# EasyEDA Pro project BlueberryPi.eprj, board PCB1 (continued)
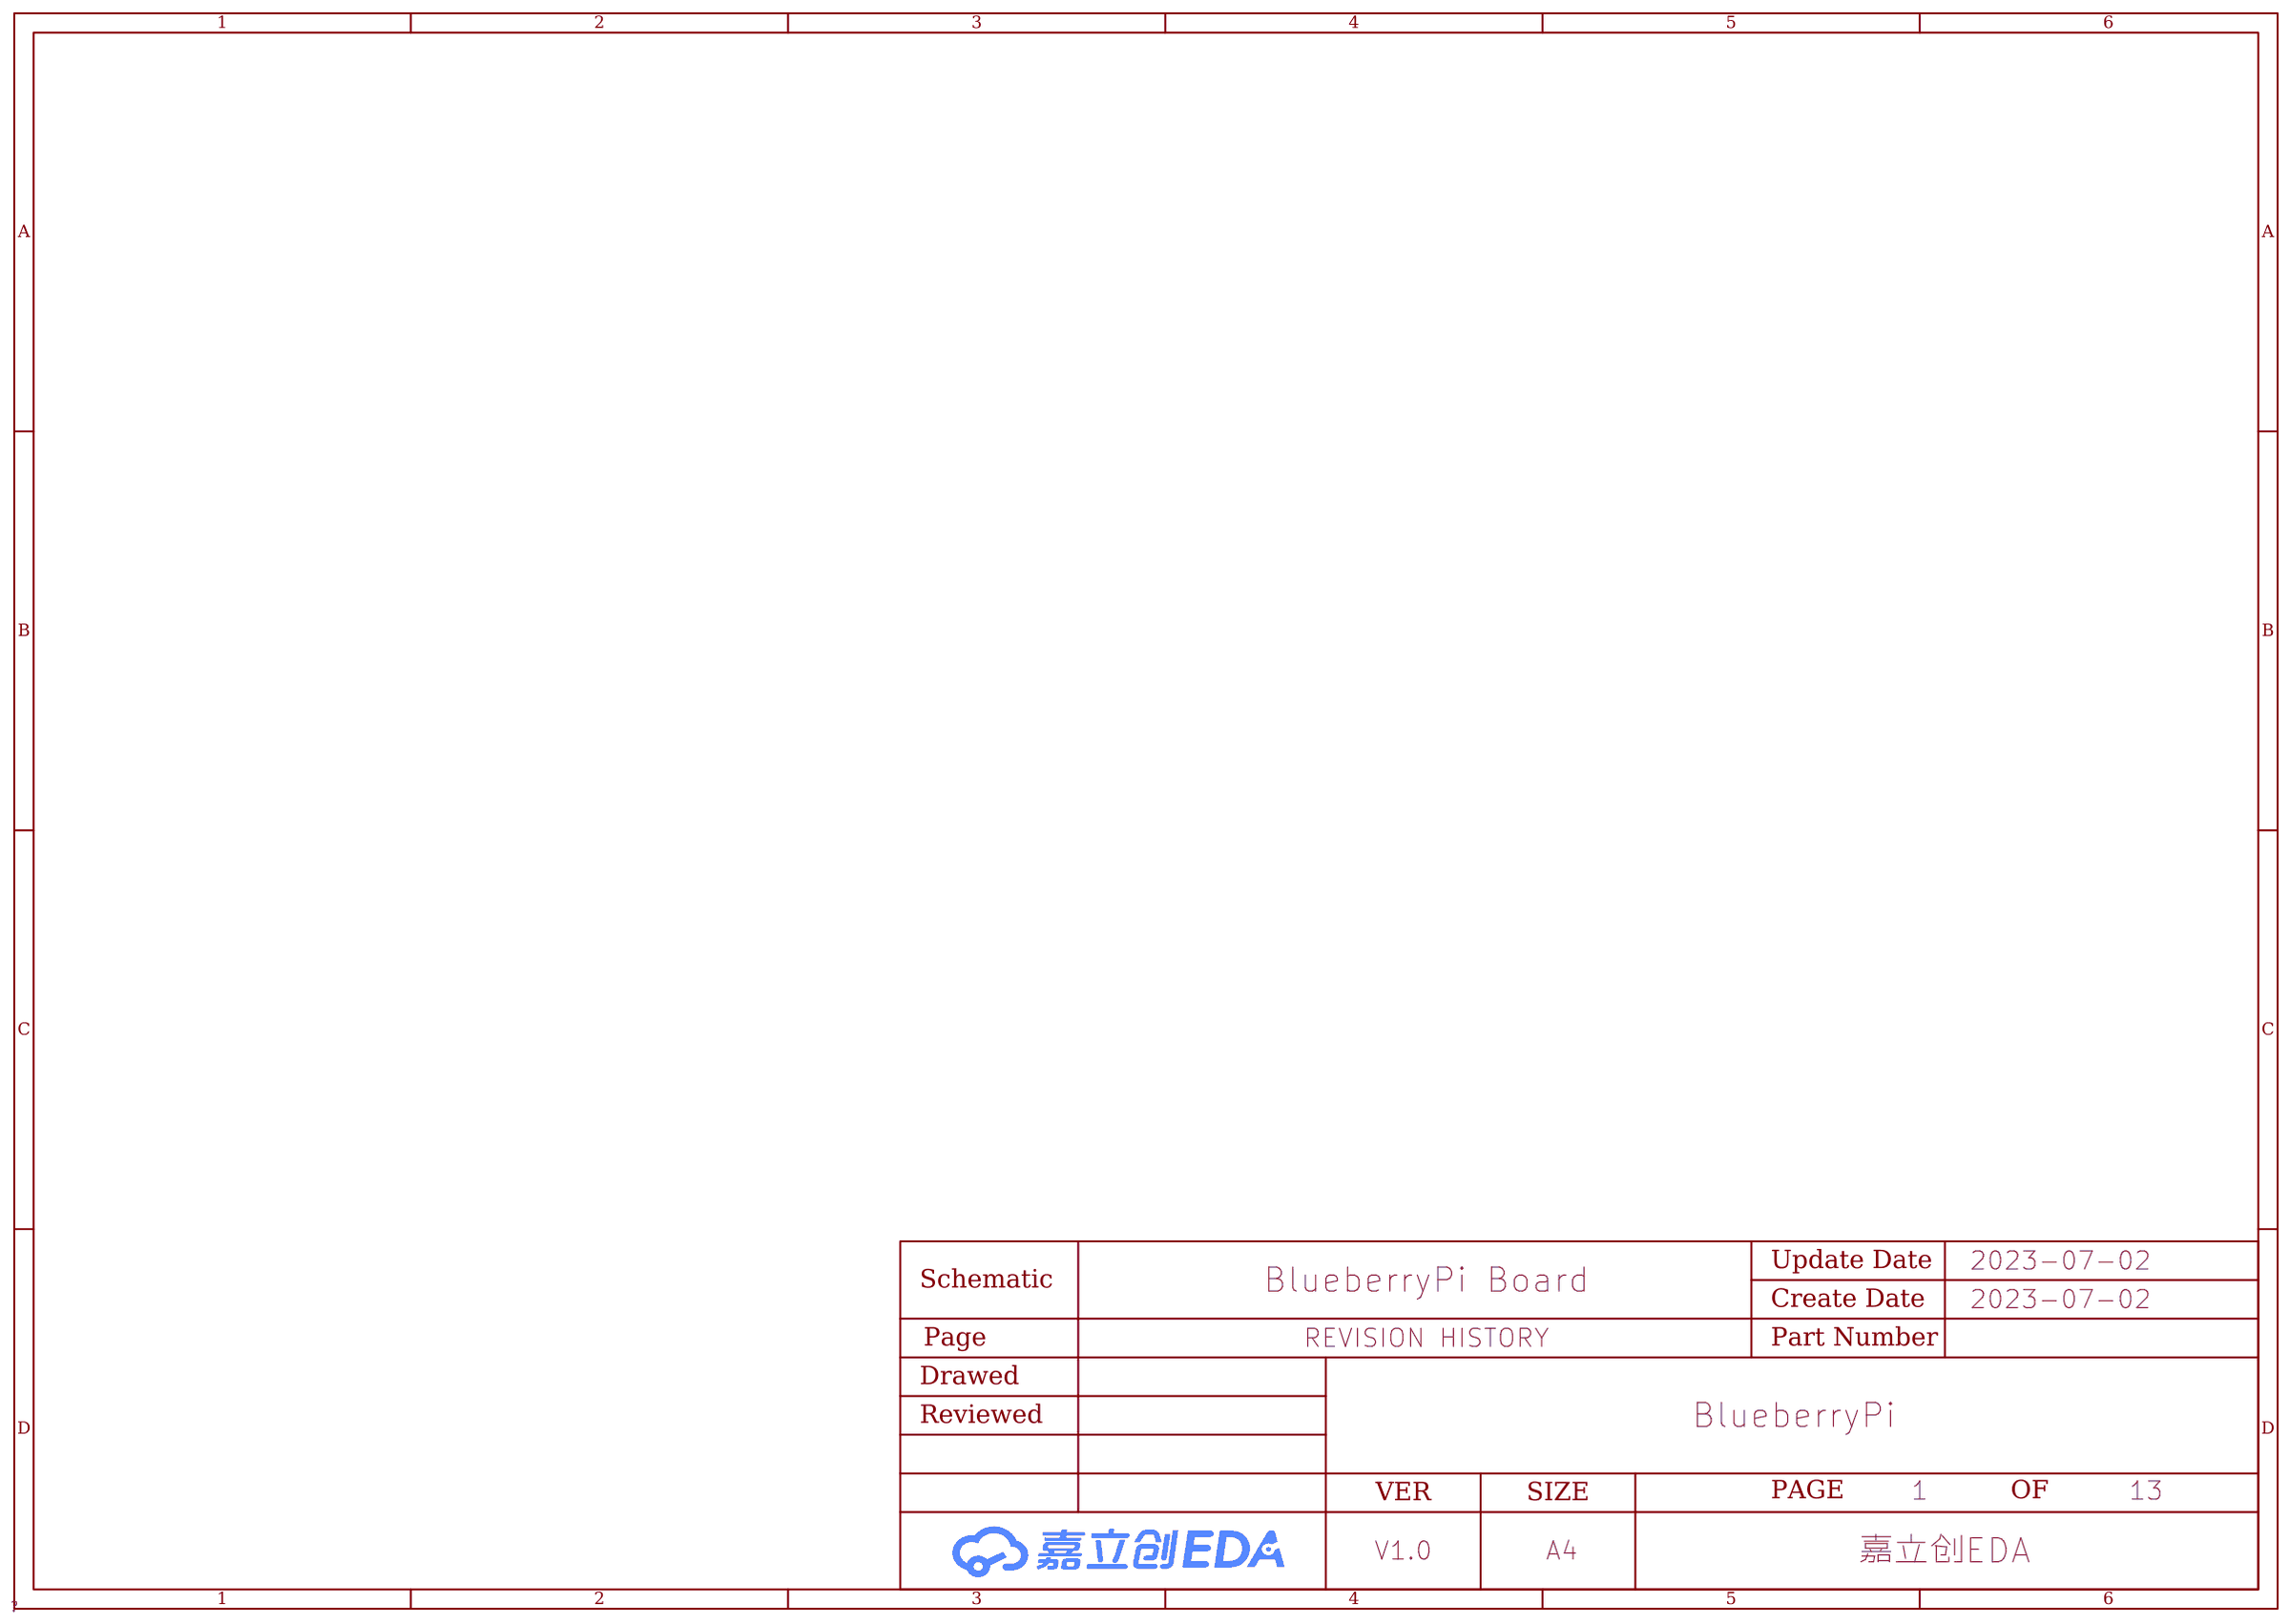
[diagram p0: REVISION HISTORY]
## Routing (per net, layer and track width the routed paths; a pad name or vN(x,y) marks a point on that pad's centre or on a via; arc(x,y) is an arc through that point) (continued)
  Bottom Layer w0.127: v2(47.58,30.34) 47.47,30.34 47.1,30.71 46.68,30.71 46.38,31.01 46.38,31.34 46.52,31.48 46.52,32.05 46.81,32.34 46.81,33.25 46.96,33.4 46.96,34.11 v2(46.84,34.24)
SDQ21: length 17.7
  Top Layer w0.127: U1.AB9 47.26,42.71 47.26,41.66 47.65,41.26 47.65,40.44 46.11,38.9 46.11,38.67 arc(46.07,38.58) 45.98,38.54 45.95,38.54 arc(45.82,38.41) 45.95,38.28 45.98,38.28 arc(46.11,38.16) 45.98,38.03 45.95,38.03 arc(45.82,37.9) 45.95,37.78 45.98,37.78 arc(46.11,37.65) 45.98,37.52 45.95,37.52 arc(45.82,37.39) 45.95,37.27 45.98,37.27 arc(46.11,37.14) 45.98,37.01 45.95,37.01 arc(45.82,36.89) 45.95,36.76 45.98,36.76 arc(46.11,36.63) 45.98,36.51 45.95,36.51 arc(45.82,36.38) 45.95,36.25 45.98,36.25 arc(46.11,36.12) 45.98,36 45.95,36 arc(45.82,35.87) 45.95,35.74 45.98,35.74 arc(46.11,35.62) 45.98,35.49 45.95,35.49 arc(45.82,35.36) 45.95,35.24 45.98,35.24 arc(46.11,35.11) 45.98,34.98 45.95,34.98 arc(45.82,34.86) 45.95,34.73 45.98,34.73 arc(46.11,34.6) 45.98,34.47 45.95,34.47 arc(45.82,34.35) 45.95,34.22 45.98,34.22 arc(46.07,34.18) 46.11,34.09 46.11,34.01 46.51,33.62 arc(46.53,33.57) v2(46.57,33.55)
  Bottom Layer w0.127: v2(46.95,30.34) 46.72,30.34 46.15,30.91 46.15,31.43 46.29,31.57 46.29,32.2 46.57,32.48 v2(46.57,33.55)
SDQ22: length 17.6
  Top Layer w0.127: U1.AC10 48.23,42.11 48.34,42.01 48.34,40.27 arc(48.37,40.18) 48.46,40.15 48.63,40.15 arc(48.76,40.02) 48.63,39.89 48.46,39.89 arc(48.34,39.77) 48.46,39.64 48.63,39.64 arc(48.76,39.51) 48.63,39.38 48.46,39.38 arc(48.37,39.35) 48.34,39.26 48.34,39.19 arc(48.37,39.1) 48.46,39.06 48.68,39.06 arc(48.8,38.93) 48.68,38.8 48,38.8 arc(47.87,38.68) 48,38.55 48.68,38.55 arc(48.8,38.42) 48.68,38.3 48,38.3 arc(47.87,38.17) 48,38.04 48.68,38.04 arc(48.8,37.92) 48.68,37.79 48.46,37.79 arc(48.37,37.75) 48.34,37.66 48.34,37.52 48.28,37.47 arc(48.19,37.43) 48.1,37.47 48.06,37.51 arc(47.88,37.51) 47.88,37.33 47.92,37.29 arc(47.96,37.2) 47.92,37.11 47.41,36.6 v2(47.41,35.61)
  Top Layer w0.254: v2(47.5,31.43) 47.58,31.35 U35.F11
  Bottom Layer w0.127: v2(47.5,31.43) 47.65,31.59 47.65,31.8 47.79,31.94 47.79,35.23 v2(47.41,35.61)
SDQ23: length 17.6
  Top Layer w0.127: v2(46.88,34.94) 47.04,35.1 47.04,36.86 arc(47.08,36.95) 47.17,36.98 47.35,36.98 arc(47.48,37.11) 47.35,37.24 47.17,37.24 arc(47.04,37.37) 47.17,37.49 47.35,37.49 arc(47.48,37.62) 47.35,37.75 47.17,37.75 arc(47.04,37.87) 47.17,38 47.35,38 arc(47.48,38.13) 47.35,38.25 47.17,38.25 arc(47.04,38.38) 47.17,38.51 47.35,38.51 arc(47.48,38.64) 47.35,38.76 47.17,38.76 arc(47.08,38.8) 47.04,38.89 47.04,39.14 47.11,39.21 arc(47.2,39.25) 47.29,39.21 47.49,39.01 arc(47.67,39.01) 47.67,39.19 47.47,39.39 arc(47.47,39.57) 47.65,39.57 47.85,39.37 arc(48.03,39.37) 48.03,39.55 47.83,39.75 arc(47.79,39.84) 47.83,39.93 48.11,40.21 48.11,41.45 47.9,41.66 47.9,42.7 U1.AB10
  Bottom Layer w0.127: v2(46.88,34.94) 47.2,34.61 47.37,34.61 47.46,34.52 47.46,34.35 47.56,34.25 47.56,32.04 46.95,31.43 v2(46.95,31.14)
SDQ24: length 22.6
  Top Layer w0.127: U35.C8 44.75,27.86 42.22,27.86 40.36,29.72 40.36,43.51 41.18,44.33 U1.Y1
SDQ25: length 22.3
  Top Layer w0.127: U35.B8 44.98,28.51 44.59,28.12 42.37,28.12 42.3,28.18 arc(42.28,28.23) 42.3,28.27 arc(42.32,28.32) 42.3,28.36 42.21,28.45 arc(42.17,28.47) 42.12,28.45 arc(42.08,28.43) 42.03,28.45 41.94,28.54 arc(41.92,28.59) 41.94,28.63 arc(41.96,28.68) 41.94,28.72 41.85,28.81 arc(41.81,28.83) 41.76,28.81 arc(41.72,28.79) 41.67,28.81 41.58,28.9 arc(41.56,28.95) 41.58,28.99 arc(41.6,29.04) 41.58,29.08 41.49,29.17 arc(41.45,29.19) 41.4,29.17 arc(41.36,29.15) 41.31,29.17 41.22,29.26 arc(41.21,29.31) 41.22,29.35 arc(41.24,29.4) 41.22,29.44 41.13,29.53 arc(41.09,29.55) 41.04,29.53 arc(41,29.51) 40.96,29.53 40.67,29.82 40.67,43.38 41.3,44.02 42.72,44.02 U1.Y2
SDQ26: length 22.4
  Top Layer w0.127: U1.AA1 41.47,43.68 40.97,43.18 40.97,30.05 41.12,29.9 arc(41.19,29.87) 41.27,29.9 arc(41.35,29.93) 41.42,29.9 41.45,29.87 arc(41.48,29.8) 41.45,29.72 arc(41.42,29.64) 41.45,29.57 41.48,29.54 arc(41.55,29.51) 41.63,29.54 arc(41.71,29.57) 41.78,29.54 41.81,29.51 arc(41.84,29.44) 41.81,29.36 arc(41.78,29.29) 41.81,29.21 41.84,29.18 arc(41.91,29.15) 41.99,29.18 arc(42.07,29.21) 42.14,29.18 42.17,29.15 arc(42.2,29.08) 42.17,29 arc(42.14,28.93) 42.17,28.85 42.2,28.82 arc(42.27,28.79) 42.35,28.82 arc(42.42,28.85) 42.5,28.82 42.53,28.8 arc(42.56,28.72) 42.53,28.64 arc(42.5,28.57) 42.53,28.49 42.65,28.37 42.77,28.37 arc(42.86,28.41) 42.89,28.5 arc(43.02,28.63) 43.15,28.5 arc(43.27,28.37) 43.4,28.5 arc(43.53,28.63) 43.66,28.5 arc(43.69,28.41) 43.78,28.37 43.81,28.35 44.45,28.35 44.65,28.55 44.65,28.88 44.91,29.13 45.21,29.13 45.62,29.54 U35.C9
SDQ27: length 22.3
  Top Layer w0.127: U1.AA2 42.71,43.36 41.68,43.36 41.25,42.93 41.25,31.56 arc(41.29,31.47) 41.38,31.44 41.55,31.44 arc(41.68,31.31) 41.55,31.18 41.38,31.18 arc(41.25,31.05) 41.38,30.93 41.55,30.93 arc(41.68,30.8) 41.55,30.67 41.38,30.67 arc(41.29,30.64) 41.25,30.55 41.25,30.45 41.34,30.36 arc(41.43,30.32) 41.52,30.36 41.57,30.41 arc(41.75,30.41) 41.75,30.23 41.7,30.18 arc(41.7,30) 41.88,30 41.93,30.05 arc(42.11,30.05) 42.11,29.87 42.06,29.82 arc(42.06,29.64) 42.24,29.64 42.29,29.69 arc(42.47,29.69) 42.47,29.51 42.42,29.46 arc(42.38,29.37) 42.42,29.28 42.56,29.13 42.73,29.13 arc(42.82,29.1) 42.86,29.01 42.86,28.98 arc(42.99,28.85) 43.11,28.98 43.11,29.01 arc(43.24,29.13) 43.37,29.01 43.37,28.98 arc(43.5,28.85) 43.62,28.98 43.62,29.01 arc(43.66,29.1) 43.75,29.13 44.57,29.13 U35.B9
SDQ28: length 22.4
  Top Layer w0.127: U35.B10 44.98,30.43 44.56,30.85 43.66,30.85 arc(43.57,30.81) 43.53,30.72 43.53,30.59 arc(43.41,30.47) 43.28,30.59 43.28,30.72 arc(43.24,30.81) 43.15,30.85 43.01,30.85 42.98,30.88 arc(42.89,30.92) 42.8,30.88 42.68,30.76 arc(42.5,30.76) 42.5,30.94 42.62,31.06 arc(42.66,31.15) 42.62,31.24 42.62,31.34 arc(42.66,31.43) 42.75,31.46 42.77,31.46 arc(42.9,31.59) 42.77,31.72 42.75,31.72 arc(42.62,31.84) 42.75,31.97 42.77,31.97 arc(42.9,32.1) 42.77,32.23 42.75,32.23 arc(42.62,32.35) 42.75,32.48 42.77,32.48 arc(42.9,32.61) 42.77,32.73 42.75,32.73 arc(42.62,32.86) 42.75,32.99 42.77,32.99 arc(42.9,33.12) 42.77,33.24 42.75,33.24 arc(42.62,33.37) 42.75,33.5 42.77,33.5 arc(42.9,33.62) 42.77,33.75 42.75,33.75 arc(42.62,33.88) 42.75,34 42.77,34 arc(42.9,34.13) 42.77,34.26 42.75,34.26 arc(42.62,34.39) 42.75,34.51 42.77,34.51 arc(42.9,34.64) 42.77,34.77 42.75,34.77 arc(42.62,34.89) 42.75,35.02 42.77,35.02 arc(42.9,35.15) 42.77,35.27 42.75,35.27 arc(42.62,35.4) 42.75,35.53 42.77,35.53 arc(42.9,35.66) 42.77,35.78 42.75,35.78 arc(42.62,35.91) 42.75,36.04 42.77,36.04 arc(42.9,36.16) 42.77,36.29 42.75,36.29 arc(42.62,36.42) 42.75,36.54 42.77,36.54 arc(42.9,36.67) 42.77,36.8 42.75,36.8 arc(42.62,36.92) 42.75,37.05 42.77,37.05 arc(42.9,37.18) 42.77,37.31 42.75,37.31 arc(42.62,37.43) 42.75,37.56 42.77,37.56 arc(42.9,37.69) 42.77,37.81 42.75,37.81 arc(42.62,37.94) 42.75,38.07 42.77,38.07 arc(42.9,38.2) 42.77,38.32 42.75,38.32 arc(42.62,38.45) 42.75,38.58 42.77,38.58 arc(42.9,38.7) 42.77,38.83 42.75,38.83 arc(42.62,38.96) 42.75,39.08 42.77,39.08 arc(42.9,39.21) 42.77,39.34 42.75,39.34 arc(42.66,39.38) 42.62,39.47 42.62,39.98 arc(42.58,40.06) 42.49,40.1 42.37,40.1 arc(42.24,40.23) 42.37,40.36 42.49,40.36 arc(42.62,40.48) 42.49,40.61 42.37,40.61 arc(42.24,40.74) 42.37,40.86 42.49,40.86 arc(42.62,40.99) 42.49,41.12 42.37,41.12 arc(42.24,41.25) 42.37,41.37 42.49,41.37 arc(42.58,41.41) 42.62,41.5 42.62,41.97 U1.AC2
SDQ29: length 22.4
  Top Layer w0.127: U1.AC3 43.21,41.91 43.21,41.8 arc(43.17,41.71) 43.08,41.68 arc(42.99,41.64) 42.96,41.55 42.96,41.55 arc(42.99,41.46) 43.08,41.42 arc(43.17,41.39) 43.21,41.3 43.21,41.29 arc(43.17,41.21) 43.08,41.17 arc(42.99,41.13) 42.96,41.04 42.96,41.04 arc(42.99,40.95) 43.08,40.92 arc(43.17,40.88) 43.21,40.79 43.21,40.78 arc(43.17,40.7) 43.08,40.66 arc(42.99,40.62) 42.96,40.54 42.96,40.53 arc(42.99,40.44) 43.08,40.41 arc(43.17,40.37) 43.21,40.28 43.21,40.28 arc(43.17,40.19) 43.08,40.15 arc(42.99,40.12) 42.96,40.03 42.96,40.02 arc(42.99,39.94) 43.08,39.9 arc(43.17,39.86) 43.21,39.77 43.21,39.27 arc(43.24,39.18) 43.33,39.15 43.46,39.15 arc(43.59,39.02) 43.46,38.89 43.33,38.89 arc(43.21,38.77) 43.33,38.64 43.46,38.64 arc(43.59,38.51) 43.46,38.39 43.33,38.39 arc(43.21,38.26) 43.33,38.13 43.46,38.13 arc(43.59,38) 43.46,37.88 43.33,37.88 arc(43.21,37.75) 43.33,37.62 43.46,37.62 arc(43.59,37.5) 43.46,37.37 43.33,37.37 arc(43.21,37.24) 43.33,37.12 43.46,37.12 arc(43.59,36.99) 43.46,36.86 43.33,36.86 arc(43.21,36.73) 43.33,36.61 43.46,36.61 arc(43.59,36.48) 43.46,36.35 43.33,36.35 arc(43.21,36.23) 43.33,36.1 43.46,36.1 arc(43.59,35.97) 43.46,35.84 43.33,35.84 arc(43.21,35.72) 43.33,35.59 43.46,35.59 arc(43.59,35.46) 43.46,35.34 43.33,35.34 arc(43.21,35.21) 43.33,35.08 43.46,35.08 arc(43.59,34.96) 43.46,34.83 43.33,34.83 arc(43.21,34.7) 43.33,34.58 43.46,34.58 arc(43.59,34.45) 43.46,34.32 43.33,34.32 arc(43.21,34.19) 43.33,34.07 43.46,34.07 arc(43.59,33.94) 43.46,33.81 43.33,33.81 arc(43.21,33.69) 43.33,33.56 43.46,33.56 arc(43.59,33.43) 43.46,33.31 43.33,33.31 arc(43.21,33.18) 43.33,33.05 43.46,33.05 arc(43.59,32.92) 43.46,32.8 43.33,32.8 arc(43.24,32.76) 43.21,32.67 43.21,32.46 43.29,32.38 arc(43.38,32.34) 43.47,32.38 43.59,32.5 arc(43.77,32.5) 43.77,32.32 43.35,31.89 arc(43.35,31.72) 43.53,31.72 43.82,32.01 arc(43.9,32.04) 43.97,32.01 44,31.98 arc(44.03,31.91) 44,31.83 arc(43.96,31.75) 44,31.67 44.06,31.61 44.39,31.61 44.85,31.14 U35.B11
SDQ30: length 22.3
  Top Layer w0.127: U1.AC4 44.33,42.18 44.53,41.99 44.53,41.75 44.34,41.57 44.34,41.44 44.5,41.28 44.67,41.28 arc(44.79,41.15) 44.67,41.03 44.5,41.03 arc(44.37,40.9) 44.5,40.77 44.67,40.77 arc(44.79,40.65) 44.67,40.52 44.5,40.52 arc(44.37,40.39) 44.5,40.27 44.67,40.27 arc(44.79,40.14) 44.67,40.01 44.5,40.01 arc(44.37,39.88) 44.5,39.76 44.67,39.76 arc(44.79,39.63) 44.67,39.5 44.5,39.5 arc(44.37,39.38) 44.5,39.25 44.67,39.25 arc(44.79,39.12) 44.67,39 44.5,39 arc(44.37,38.87) 44.5,38.74 44.67,38.74 arc(44.79,38.61) 44.67,38.49 44.5,38.49 arc(44.37,38.36) 44.5,38.23 44.67,38.23 arc(44.79,38.11) 44.67,37.98 44.5,37.98 arc(44.37,37.85) 44.5,37.73 44.67,37.73 arc(44.79,37.6) 44.67,37.47 44.5,37.47 arc(44.37,37.34) 44.5,37.22 44.67,37.22 arc(44.79,37.09) 44.67,36.96 44.5,36.96 arc(44.37,36.84) 44.5,36.71 44.67,36.71 arc(44.79,36.58) 44.67,36.45 44.5,36.45 arc(44.37,36.33) 44.5,36.2 44.67,36.2 arc(44.79,36.07) 44.67,35.95 44.5,35.95 arc(44.37,35.82) 44.5,35.69 44.67,35.69 arc(44.79,35.57) 44.67,35.44 44.5,35.44 arc(44.37,35.31) 44.5,35.19 44.67,35.19 arc(44.79,35.06) 44.67,34.93 44.5,34.93 arc(44.37,34.8) 44.5,34.68 44.67,34.68 arc(44.79,34.55) 44.67,34.42 44.5,34.42 arc(44.37,34.3) 44.5,34.17 44.67,34.17 arc(44.79,34.04) 44.67,33.92 44.5,33.92 arc(44.37,33.79) 44.5,33.66 44.67,33.66 arc(44.79,33.53) 44.67,33.41 44.5,33.41 arc(44.41,33.37) 44.37,33.28 44.37,33.15 44.48,33.05 45.19,33.05 45.35,32.89 45.35,32.13 45.31,32.1 45.31,31.7 45.63,31.38 U35.C11
SDQ31: length 22.4
  Top Layer w0.127: U35.C10 45.3,30.67 45.3,31.32 45.06,31.56 44.88,31.56 44.65,31.79 44.65,32.13 44.49,32.28 44.31,32.28 44.02,32.58 44.02,32.99 arc(44,33.03) 43.95,33.05 arc(43.91,33.07) 43.89,33.12 43.89,33.24 arc(43.91,33.29) 43.95,33.31 44.08,33.31 arc(44.13,33.33) 44.15,33.37 44.15,33.5 arc(44.13,33.54) 44.08,33.56 43.95,33.56 arc(43.91,33.58) 43.89,33.62 43.89,33.75 arc(43.91,33.8) 43.95,33.81 44.08,33.81 arc(44.13,33.83) 44.15,33.88 44.15,34.01 arc(44.13,34.05) 44.08,34.07 43.95,34.07 arc(43.91,34.09) 43.89,34.13 43.89,34.26 arc(43.91,34.3) 43.95,34.32 44.08,34.32 arc(44.13,34.34) 44.15,34.39 44.15,34.51 arc(44.13,34.56) 44.08,34.58 43.95,34.58 arc(43.91,34.6) 43.89,34.64 43.89,34.77 arc(43.91,34.81) 43.95,34.83 44.08,34.83 arc(44.13,34.85) 44.15,34.89 44.15,35.02 arc(44.13,35.07) 44.08,35.09 43.95,35.09 arc(43.91,35.1) 43.89,35.15 43.89,35.28 arc(43.91,35.32) 43.95,35.34 44.08,35.34 arc(44.13,35.36) 44.15,35.4 44.15,35.53 arc(44.13,35.57) 44.08,35.59 43.95,35.59 arc(43.91,35.61) 43.89,35.66 43.89,35.78 arc(43.91,35.83) 43.95,35.85 44.08,35.85 arc(44.13,35.87) 44.15,35.91 44.15,36.04 arc(44.13,36.08) 44.08,36.1 43.95,36.1 arc(43.91,36.12) 43.89,36.16 43.89,36.29 arc(43.91,36.34) 43.95,36.36 44.08,36.36 arc(44.13,36.37) 44.15,36.42 44.15,36.55 arc(44.13,36.59) 44.08,36.61 43.95,36.61 arc(43.91,36.63) 43.89,36.67 43.89,36.8 arc(43.91,36.84) 43.95,36.86 44.08,36.86 arc(44.13,36.88) 44.15,36.93 44.15,37.05 arc(44.13,37.1) 44.08,37.12 43.95,37.12 arc(43.91,37.14) 43.89,37.18 43.89,37.31 arc(43.91,37.35) 43.95,37.37 44.08,37.37 arc(44.13,37.39) 44.15,37.43 44.15,37.56 arc(44.13,37.61) 44.08,37.62 43.95,37.62 arc(43.91,37.64) 43.89,37.69 43.89,37.82 arc(43.91,37.86) 43.95,37.88 44.08,37.88 arc(44.13,37.9) 44.15,37.94 44.15,38.07 arc(44.13,38.11) 44.08,38.13 arc(44.04,38.15) 44.02,38.2 44.02,39.08 arc(43.98,39.17) 43.89,39.2 43.84,39.2 arc(43.71,39.33) 43.84,39.46 43.89,39.46 arc(44.02,39.58) 43.89,39.71 43.56,39.71 arc(43.43,39.84) 43.56,39.97 43.89,39.97 arc(44.02,40.09) 43.89,40.22 43.56,40.22 arc(43.43,40.35) 43.56,40.47 43.89,40.47 arc(44.02,40.6) 43.89,40.73 43.56,40.73 arc(43.43,40.85) 43.56,40.98 43.89,40.98 arc(44.02,41.11) 43.89,41.23 43.56,41.23 arc(43.43,41.36) 43.56,41.49 43.89,41.49 arc(44.02,41.62) 43.89,41.74 43.75,41.74 arc(43.62,41.87) 43.75,42 43.89,42 arc(43.98,42.03) 44.02,42.12 44.02,42.72 U1.AB4
SDQM0: length 17
  Top Layer w0.127: U1.AC18 53.87,41.94 v2(53.87,41.91)
  Bottom Layer w0.127: v2(50.83,28.74) 50.83,28.57 51.03,28.38 52.84,28.38 53.75,29.28 53.75,33.45 54,33.71 54,41.78 v2(53.87,41.91)
SDQM1: length 23
  Top Layer w0.127: U35.P8 52.78,28.54 53.76,27.56 56.48,27.56 58.39,29.48 58.39,43.29 57.35,44.33 U1.Y23
SDQM2: length 17.7
  Top Layer w0.127: U1.AB11 48.58,42.73 48.58,40.96 48.7,40.83 v2(48.7,40.65)
  Bottom Layer w0.127: v2(48.7,40.65) 48.7,40.64 48.61,40.54 arc(48.52,40.51) 48.43,40.54 47.64,41.33 arc(47.46,41.33) 47.46,41.15 48.25,40.36 arc(48.28,40.27) 48.25,40.18 48.04,39.98 48.04,39.73 48.45,39.32 48.45,31.57 48.62,31.41 48.62,29.13 v2(48.23,28.74)
SDQM3: length 22.3
  Top Layer w0.127: U35.D8 46.57,29.03 46.57,31.41 46.45,31.53 46.21,31.53 45.98,31.76 45.98,32.49 46.11,32.62 46.11,33.02 45.89,33.23 arc(45.81,33.27) 45.74,33.23 arc(45.66,33.2) 45.58,33.23 45.56,33.26 arc(45.52,33.34) 45.56,33.41 arc(45.59,33.49) 45.56,33.57 45.53,33.59 arc(45.44,33.63) 45.35,33.59 45.26,33.5 arc(45.09,33.5) 45.09,33.68 45.18,33.77 arc(45.21,33.86) 45.18,33.95 45.03,34.09 45.03,34.18 arc(45.07,34.27) 45.16,34.3 45.21,34.3 arc(45.34,34.43) 45.21,34.56 45.16,34.56 arc(45.03,34.69) 45.16,34.81 45.21,34.81 arc(45.34,34.94) 45.21,35.07 45.16,35.07 arc(45.03,35.19) 45.16,35.32 45.21,35.32 arc(45.34,35.45) 45.21,35.57 45.16,35.57 arc(45.03,35.7) 45.16,35.83 45.21,35.83 arc(45.34,35.96) 45.21,36.08 45.16,36.08 arc(45.03,36.21) 45.16,36.34 45.21,36.34 arc(45.34,36.46) 45.21,36.59 45.16,36.59 arc(45.03,36.72) 45.16,36.84 45.21,36.84 arc(45.34,36.97) 45.21,37.1 45.16,37.1 arc(45.03,37.23) 45.16,37.35 45.21,37.35 arc(45.34,37.48) 45.21,37.61 45.16,37.61 arc(45.03,37.73) 45.16,37.86 45.21,37.86 arc(45.34,37.99) 45.21,38.11 45.16,38.11 arc(45.03,38.24) 45.16,38.37 45.21,38.37 arc(45.34,38.5) 45.21,38.62 45.16,38.62 arc(45.03,38.75) 45.16,38.88 45.21,38.88 arc(45.34,39) 45.21,39.13 45.16,39.13 arc(45.03,39.26) 45.16,39.38 45.21,39.38 arc(45.34,39.51) 45.21,39.64 45.16,39.64 arc(45.03,39.77) 45.16,39.89 45.21,39.89 arc(45.34,40.02) 45.21,40.15 45.16,40.15 arc(45.03,40.27) 45.16,40.4 45.21,40.4 arc(45.34,40.53) 45.21,40.65 45.16,40.65 arc(45.03,40.78) 45.16,40.91 45.21,40.91 arc(45.34,41.04) 45.21,41.16 45.16,41.16 arc(45.03,41.29) 45.16,41.42 45.21,41.42 arc(45.34,41.54) 45.21,41.67 45.16,41.67 arc(45.07,41.71) 45.03,41.8 45.03,41.86 44.65,42.24 44.65,42.7 U1.AB5
SDQS0N: length 16.8
  Top Layer w0.102: v2(51.97,40.84) 51.84,40.97 51.84,42.74 U1.AB16
  Bottom Layer w0.102: v2(51.97,40.84) 51.97,40.59 51.84,40.47 51.84,40.32 50.47,38.95 50.47,38.49 arc(50.5,38.42) 50.56,38.39 arc(50.79,38.3) 50.89,38.07 50.89,38.06 arc(50.79,37.83) 50.56,37.73 arc(50.5,37.7) 50.47,37.64 50.47,37.62 arc(50.5,37.56) 50.56,37.53 arc(50.79,37.43) 50.89,37.2 50.89,37.19 arc(50.79,36.96) 50.56,36.87 arc(50.5,36.84) 50.47,36.77 50.47,36.76 arc(50.5,36.69) 50.56,36.67 arc(50.79,36.57) 50.89,36.34 50.89,36.33 arc(50.79,36.1) 50.56,36 arc(50.5,35.98) 50.47,35.91 50.47,35.9 arc(50.5,35.83) 50.56,35.8 arc(50.79,35.71) 50.89,35.48 50.89,35.46 arc(50.79,35.24) 50.56,35.14 arc(50.5,35.11) 50.47,35.05 50.47,35.03 arc(50.5,34.97) 50.56,34.94 arc(50.79,34.84) 50.89,34.61 50.89,34.6 arc(50.79,34.37) 50.56,34.28 arc(50.5,34.25) 50.47,34.18 50.47,34.17 arc(50.5,34.1) 50.56,34.07 arc(50.79,33.98) 50.89,33.75 50.89,33.74 arc(50.79,33.51) 50.56,33.41 arc(50.5,33.39) 50.47,33.32 50.47,33.31 arc(50.5,33.24) 50.56,33.21 arc(50.79,33.12) 50.89,32.89 50.89,32.87 arc(50.79,32.64) 50.56,32.55 arc(50.5,32.52) 50.47,32.45 50.47,31.13 50.74,30.85 50.79,30.85 50.83,30.89 v2(50.83,31.14)
SDQS0P: length 16.8
  Top Layer w0.102: U1.AC15 51.48,42.14 51.61,42.01 51.61,41.81 51.49,41.69 51.49,41.53 51.61,41.41 51.61,41.27 51.46,41.12 v2(51.46,40.84)
  Bottom Layer w0.102: v2(50.83,30.34) 50.83,30.59 50.79,30.63 50.65,30.63 50.54,30.73 50.42,30.73 50.34,30.81 50.34,30.93 50.24,31.03 50.24,31.1 50.18,31.16 50.18,31.3 50.24,31.36 50.24,31.5 50.18,31.56 50.18,31.71 50.24,31.77 50.24,31.99 50.18,32.06 50.18,32.2 50.24,32.26 50.24,32.45 arc(50.34,32.68) 50.56,32.78 arc(50.63,32.81) 50.66,32.87 50.66,32.89 arc(50.63,32.95) 50.56,32.98 arc(50.34,33.08) 50.24,33.31 50.24,33.32 arc(50.34,33.55) 50.56,33.64 arc(50.63,33.67) 50.66,33.74 50.66,33.75 arc(50.63,33.82) 50.56,33.85 arc(50.34,33.94) 50.24,34.17 50.24,34.18 arc(50.34,34.41) 50.56,34.51 arc(50.63,34.53) 50.66,34.6 50.66,34.61 arc(50.63,34.68) 50.56,34.71 arc(50.34,34.8) 50.24,35.03 50.24,35.05 arc(50.34,35.27) 50.56,35.37 arc(50.63,35.4) 50.66,35.46 50.66,35.48 arc(50.63,35.55) 50.56,35.57 arc(50.34,35.67) 50.24,35.9 50.24,35.91 arc(50.34,36.14) 50.56,36.23 arc(50.63,36.26) 50.66,36.33 50.66,36.34 arc(50.63,36.41) 50.56,36.44 arc(50.34,36.53) 50.24,36.76 50.24,36.77 arc(50.34,37) 50.56,37.1 arc(50.63,37.12) 50.66,37.19 50.66,37.2 arc(50.63,37.27) 50.56,37.3 arc(50.34,37.39) 50.24,37.62 50.24,37.64 arc(50.34,37.87) 50.56,37.96 arc(50.63,37.99) 50.66,38.06 50.66,38.07 arc(50.63,38.14) 50.56,38.16 arc(50.34,38.26) 50.24,38.49 50.24,39.04 51.61,40.42 51.61,40.47 51.46,40.62 v2(51.46,40.84)
SDQS1N: length 22.8
  Top Layer w0.102: U35.P11 52.79,31.14 53.11,30.82 53.11,30.18 53.23,30.05 54.89,30.05 55.25,30.4 55.25,30.84 56.64,32.23 56.64,32.74 arc(56.61,32.81) 56.54,32.84 56.48,32.84 arc(56.15,33.17) 56.48,33.5 56.54,33.5 arc(56.64,33.6) 56.54,33.71 56.48,33.71 arc(56.15,34.04) 56.48,34.37 56.54,34.37 arc(56.64,34.47) 56.54,34.57 56.48,34.57 arc(56.15,34.9) 56.48,35.23 56.54,35.23 arc(56.64,35.33) 56.54,35.43 56.48,35.43 arc(56.15,35.76) 56.48,36.09 56.54,36.09 arc(56.64,36.2) 56.54,36.3 56.48,36.3 arc(56.15,36.63) 56.48,36.96 56.54,36.96 arc(56.64,37.06) 56.54,37.16 56.48,37.16 arc(56.15,37.49) 56.48,37.82 56.54,37.82 arc(56.64,37.92) 56.54,38.02 56.48,38.02 arc(56.15,38.35) 56.48,38.68 56.54,38.68 arc(56.64,38.79) 56.54,38.89 56.48,38.89 arc(56.15,39.22) 56.48,39.55 56.54,39.55 arc(56.64,39.65) 56.54,39.75 56.48,39.75 arc(56.15,40.08) 56.48,40.41 56.54,40.41 arc(56.61,40.44) 56.64,40.51 56.64,41.3 56.26,41.68 56.26,41.83 56.21,41.89 56.06,41.89 55.74,42.21 55.74,42.74 U1.AB22
SDQS1P: length 22.8
  Top Layer w0.102: U1.AC22 56.03,42.3 56.22,42.11 56.36,42.11 56.49,41.99 56.49,41.78 56.62,41.66 56.74,41.66 56.87,41.53 56.87,40.51 arc(56.77,40.28) 56.54,40.18 56.48,40.18 arc(56.38,40.08) 56.48,39.98 56.54,39.98 arc(56.87,39.65) 56.54,39.32 56.48,39.32 arc(56.38,39.22) 56.48,39.12 56.54,39.12 arc(56.87,38.79) 56.54,38.46 56.48,38.46 arc(56.38,38.35) 56.48,38.25 56.54,38.25 arc(56.87,37.92) 56.54,37.59 56.48,37.59 arc(56.38,37.49) 56.48,37.39 56.54,37.39 arc(56.87,37.06) 56.54,36.73 56.48,36.73 arc(56.38,36.63) 56.48,36.53 56.54,36.53 arc(56.87,36.2) 56.54,35.87 56.48,35.87 arc(56.38,35.76) 56.48,35.66 56.54,35.66 arc(56.87,35.33) 56.54,35 56.48,35 arc(56.38,34.9) 56.48,34.8 56.54,34.8 arc(56.87,34.47) 56.54,34.14 56.48,34.14 arc(56.38,34.04) 56.48,33.93 56.54,33.93 arc(56.87,33.6) 56.54,33.27 56.48,33.27 arc(56.38,33.17) 56.48,33.07 56.54,33.07 arc(56.77,32.97) 56.87,32.74 56.87,32.14 56.32,31.59 arc(56.28,31.5) 56.32,31.41 56.34,31.39 arc(56.34,31.22) 56.16,31.22 56.14,31.23 arc(55.96,31.23) 55.96,31.05 55.98,31.04 arc(55.98,30.86) 55.8,30.86 55.78,30.87 arc(55.69,30.91) 55.6,30.87 55.47,30.74 55.47,30.31 55.41,30.25 arc(55.39,30.18) 55.41,30.11 arc(55.44,30.05) 55.41,29.98 55.37,29.93 arc(55.3,29.91) 55.23,29.93 arc(55.17,29.96) 55.1,29.93 54.98,29.82 53.14,29.82 52.78,30.18 U35.P10
SDQS2N: length 17.7
  Top Layer w0.102: U1.AC8 46.93,42.14 46.87,42.07 46.87,41.74 47.04,41.56 47.04,40.99 v2(47.26,40.78)
  Bottom Layer w0.102: v2(48.23,31.14) 48.23,31.15 48.23,36.27 arc(48.14,36.5) 47.9,36.6 47.41,36.6 arc(47.31,36.7) 47.41,36.8 47.9,36.8 arc(48.23,37.13) 47.9,37.46 47.41,37.46 arc(47.31,37.57) 47.41,37.67 47.9,37.67 arc(48.14,37.76) 48.23,38 48.23,38.21 47.94,38.5 arc(47.91,38.57) 47.94,38.65 48.11,38.82 arc(48.11,39.29) 47.65,39.29 47.47,39.11 arc(47.4,39.08) 47.33,39.11 47.13,39.31 47.13,39.39 arc(47.16,39.48) 47.25,39.51 47.56,39.51 arc(47.69,39.64) 47.56,39.77 47.25,39.77 arc(47.16,39.81) 47.13,39.89 47.13,40 arc(47.16,40.09) 47.25,40.13 47.51,40.13 arc(47.64,40.26) 47.51,40.38 47.25,40.38 arc(47.16,40.42) 47.13,40.51 47.13,40.72 47.19,40.78 v2(47.26,40.78)
SDQS2P: length 17.7
  Top Layer w0.102: v2(46.67,40.95) 46.82,41.09 46.82,41.47 46.64,41.65 46.64,42.74 U1.AB8
  Bottom Layer w0.102: v2(48.23,30.34) 47.87,30.7 47.87,31.71 48.01,31.85 48.01,36.27 arc(47.98,36.34) 47.9,36.37 47.41,36.37 arc(47.08,36.7) 47.41,37.03 47.9,37.03 arc(48.01,37.13) 47.9,37.23 47.41,37.23 arc(47.08,37.57) 47.41,37.9 47.9,37.9 arc(47.98,37.93) 48.01,38 48.01,38.11 47.78,38.34 arc(47.68,38.57) 47.78,38.81 47.95,38.98 arc(47.95,39.13) 47.81,39.13 47.63,38.95 arc(47.4,38.85) 47.16,38.95 46.9,39.22 46.9,40.72 v2(46.67,40.95)
SDQS3N: length 22.5
  Top Layer w0.102: U1.AB2 42.69,42.69 42.11,42.69 41.88,42.46 41.88,39.83 arc(41.91,39.77) 41.97,39.75 arc(42.19,39.66) 42.28,39.44 42.28,39.4 arc(42.19,39.18) 41.97,39.09 arc(41.91,39.06) 41.88,39 41.88,38.97 arc(41.91,38.91) 41.97,38.88 arc(42.19,38.79) 42.28,38.57 42.28,38.54 arc(42.19,38.32) 41.97,38.22 arc(41.91,38.2) 41.88,38.14 41.88,38.1 arc(41.91,38.05) 41.97,38.02 arc(42.19,37.93) 42.28,37.71 42.28,37.67 arc(42.19,37.45) 41.97,37.36 arc(41.91,37.34) 41.88,37.28 41.88,37.24 arc(41.91,37.18) 41.97,37.16 arc(42.19,37.07) 42.28,36.85 42.28,36.81 arc(42.19,36.59) 41.97,36.5 arc(41.91,36.47) 41.88,36.41 41.88,36.38 arc(41.91,36.32) 41.97,36.29 arc(42.19,36.2) 42.28,35.98 42.28,35.94 arc(42.19,35.72) 41.97,35.63 arc(41.91,35.61) 41.88,35.55 41.88,35.51 arc(41.91,35.45) 41.97,35.43 arc(42.19,35.34) 42.28,35.12 42.28,35.08 arc(42.19,34.86) 41.97,34.77 arc(41.91,34.75) 41.88,34.69 41.88,34.65 arc(41.91,34.59) 41.97,34.57 arc(42.19,34.48) 42.28,34.26 42.28,34.22 arc(42.19,34) 41.97,33.91 arc(41.91,33.88) 41.88,33.82 41.88,33.79 arc(41.91,33.73) 41.97,33.7 arc(42.19,33.61) 42.28,33.39 42.28,33.35 arc(42.19,33.13) 41.97,33.04 arc(41.91,33.02) 41.88,32.96 41.88,32.92 arc(41.91,32.86) 41.97,32.84 arc(42.19,32.75) 42.28,32.53 42.28,32.49 arc(42.19,32.27) 41.97,32.18 arc(41.91,32.15) 41.88,32.1 41.88,31.92 42.19,31.61 42.19,30.61 42.54,30.25 43.69,30.25 43.89,30.06 45.8,30.06 46,30.26 46,30.86 U35.D11
SDQS3P: length 22.5
  Top Layer w0.102: U35.D10 46.28,30.2 45.91,29.83 43.79,29.83 43.6,30.02 43.27,30.02 arc(43.18,29.99) 43.14,29.9 43.14,29.82 arc(43.01,29.69) 42.89,29.82 42.89,29.9 arc(42.85,29.99) 42.76,30.02 42.45,30.02 41.96,30.51 41.96,31.52 41.66,31.82 41.66,32.1 arc(41.75,32.32) 41.97,32.41 arc(42.03,32.43) 42.05,32.49 42.05,32.53 arc(42.03,32.59) 41.97,32.61 arc(41.75,32.7) 41.66,32.92 41.66,32.96 arc(41.75,33.18) 41.97,33.27 arc(42.03,33.3) 42.05,33.35 42.05,33.39 arc(42.03,33.45) 41.97,33.47 arc(41.75,33.57) 41.66,33.79 41.66,33.82 arc(41.75,34.04) 41.97,34.14 arc(42.03,34.16) 42.05,34.22 42.05,34.26 arc(42.03,34.31) 41.97,34.34 arc(41.75,34.43) 41.66,34.65 41.66,34.69 arc(41.75,34.91) 41.97,35 arc(42.03,35.02) 42.05,35.08 42.05,35.12 arc(42.03,35.18) 41.97,35.2 arc(41.75,35.29) 41.66,35.51 41.66,35.55 arc(41.75,35.77) 41.97,35.86 arc(42.03,35.89) 42.05,35.94 42.05,35.98 arc(42.03,36.04) 41.97,36.06 arc(41.75,36.16) 41.66,36.38 41.66,36.41 arc(41.75,36.63) 41.97,36.73 arc(42.03,36.75) 42.05,36.81 42.05,36.85 arc(42.03,36.9) 41.97,36.93 arc(41.75,37.02) 41.66,37.24 41.66,37.28 arc(41.75,37.5) 41.97,37.59 arc(42.03,37.61) 42.05,37.67 42.05,37.71 arc(42.03,37.77) 41.97,37.79 arc(41.75,37.88) 41.66,38.1 41.66,38.14 arc(41.75,38.36) 41.97,38.45 arc(42.03,38.48) 42.05,38.54 42.05,38.57 arc(42.03,38.63) 41.97,38.66 arc(41.75,38.75) 41.66,38.97 41.66,39 arc(41.75,39.23) 41.97,39.32 arc(42.03,39.34) 42.05,39.4 42.05,39.44 arc(42.03,39.5) 41.97,39.52 arc(41.75,39.61) 41.66,39.83 41.66,42.56 42.02,42.92 42.27,42.92 U1.AB1
